# EasyEDA Pro project kuafu01_030内部老化方案.eprj, board PCB4 (continued)
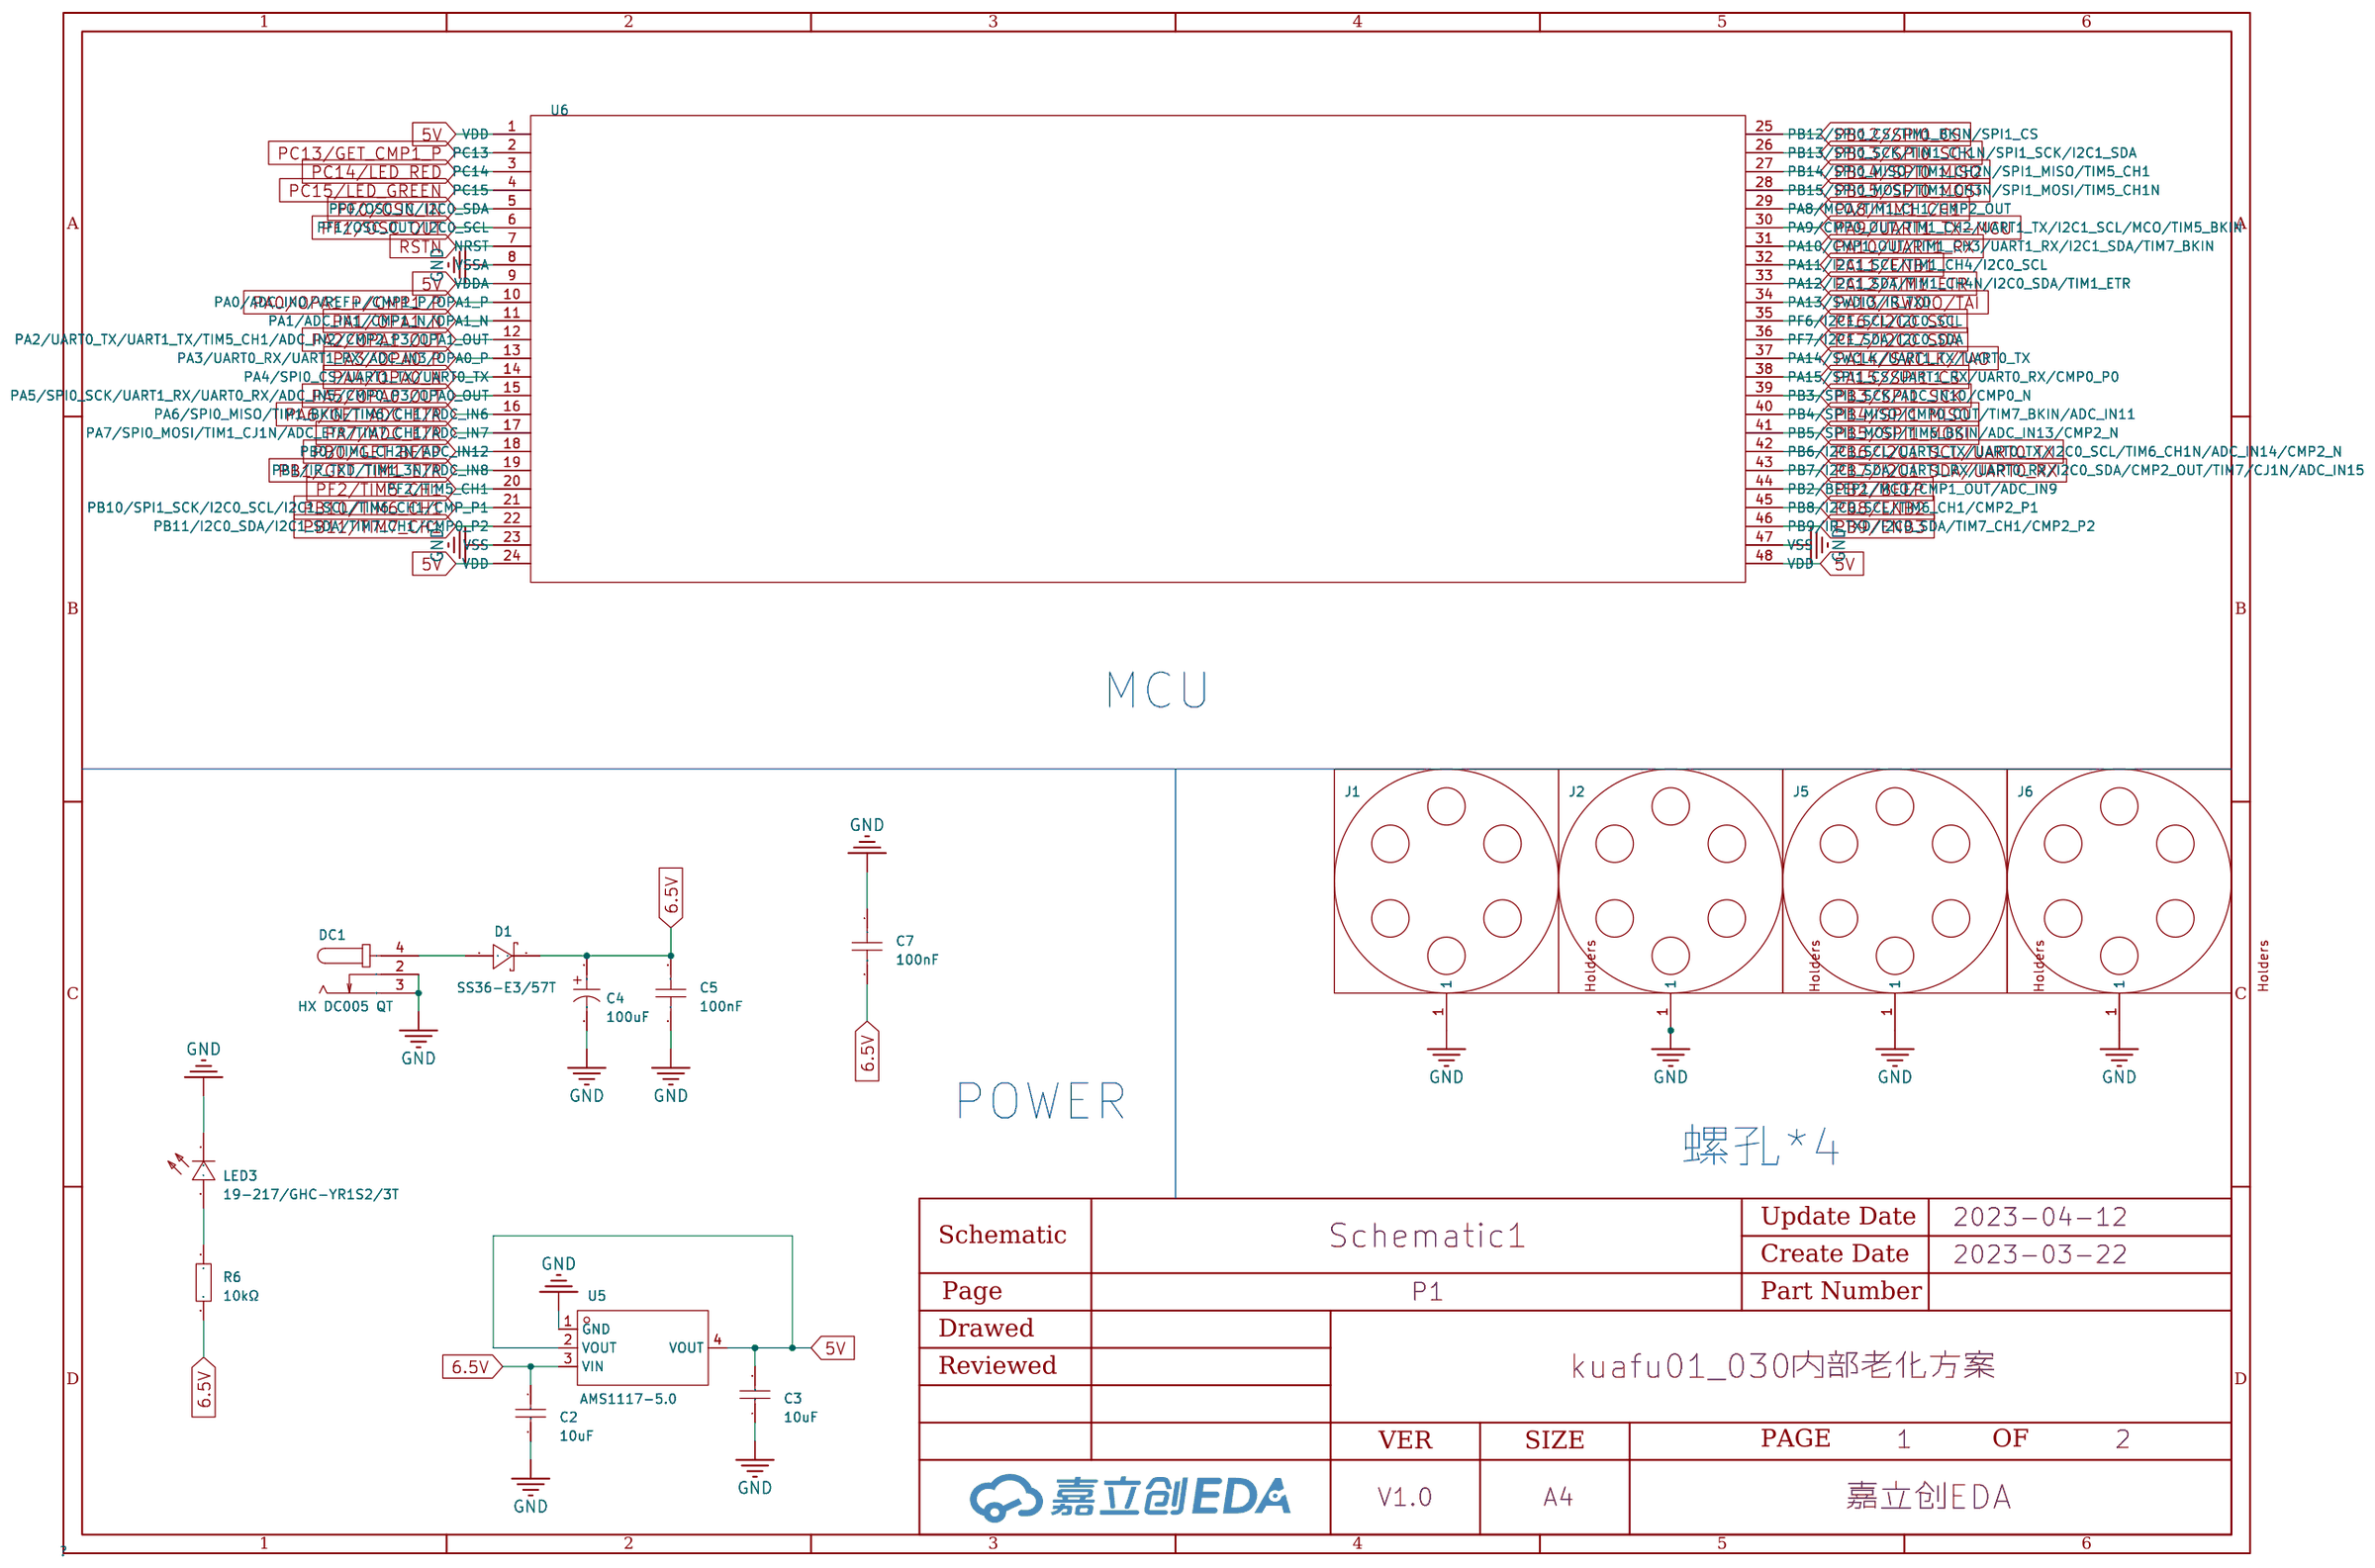
[diagram p0: P1]
## Nets (continued)
GND: C1.2 C1#2.2 C1#3.2 C1#4.2 C1#5.2 C1#6.2 C1#7.2 C1#8.2 C1#9.2 C1#10.2 C1#11.2 C1#12.2 C1#13.2 C1#14.2 C1#15.2 C1#16.2 C1#17.2 C1#18.2 C1#19.2 C1#20.2 C1#21.2 C1#22.2 C1#23.2 C1#24.2 C1#25.2 C1#26.2 C1#27.2 C1#28.2 C1#29.2 C1#30.2 C1#31.2 C1#32.2 C1#33.2 C1#34.2 C1#35.2 C1#36.2 C1#37.2 C1#38.2 C1#39.2 C1#40.2 C2.2 C3.1 C3#2.1 C3#3.1 C3#4.1 C4.2 C5.1 C6.1 C6#2.1 C6#3.1 C6#4.1 C6#5.1 C6#6.1 C6#7.1 C6#8.1 C6#9.1 C6#10.1 C6#11.1 C6#12.1 C6#13.1 C6#14.1 C6#15.1 C6#16.1 C6#17.1 C6#18.1 C6#19.1 C6#20.1 C6#21.1 C6#22.1 C6#23.1 C6#24.1 C6#25.1 C6#26.1 C6#27.1 C6#28.1 C6#29.1 C6#30.1 C6#31.1 C6#32.1 C6#33.1 C6#34.1 C6#35.1 C6#36.1 C6#37.1 C6#38.1 C6#39.1 C6#40.1 C7.1 CN1.9 CN1#2.9 CN1#3.9 CN1#4.9 CN1#5.9 CN1#6.9 CN1#7.9 CN1#8.9 CN1#9.9 CN1#10.9 CN1#11.9 CN1#12.9 CN1#13.9 CN1#14.9 CN1#15.9 CN1#16.9 CN1#17.9 CN1#18.9 CN1#19.9 CN1#20.9 CN1#21.9 CN1#22.9 CN1#23.9 CN1#24.9 CN1#25.9 CN1#26.9 CN1#27.9 CN1#28.9 CN1#29.9 CN1#30.9 CN1#31.9 CN1#32.9 CN1#33.9 CN1#34.9 CN1#35.9 CN1#36.9 CN1#37.9 CN1#38.9 CN1#39.9 CN1#40.9 CN2.3 CN2#2.3 CN2#3.3 CN2#4.3 CN2#5.3 CN2#6.3 CN2#7.3 CN2#8.3 CN2#9.3 CN2#10.3 CN2#11.3 CN2#12.3 CN2#13.3 CN2#14.3 CN2#15.3 CN2#16.3 CN2#17.3 CN2#18.3 CN2#19.3 CN2#20.3 CN2#21.3 CN2#22.3 CN2#23.3 CN2#24.3 CN2#25.3 CN2#26.3 CN2#27.3 CN2#28.3 CN2#29.3 CN2#30.3 CN2#31.3 CN2#32.3 CN2#33.3 CN2#34.3 CN2#35.3 CN2#36.3 CN2#37.3 CN2#38.3 CN2#39.3 CN2#40.3 DC1.2 DC1.3 J1.1 J2.1 J5.1 J6.1 LED3.1 U1.3 U1#2.3 U1#3.3 U1#4.3 U1#5.3 U1#6.3 U1#7.3 U1#8.3 U1#9.3 U1#10.3 U1#11.3 U1#12.3 U1#13.3 U1#14.3 U1#15.3 U1#16.3 U1#17.3 U1#18.3 U1#19.3 U1#20.3 U1#21.3 U1#22.3 U1#23.3 U1#24.3 U1#25.3 U1#26.3 U1#27.3 U1#28.3 U1#29.3 U1#30.3 U1#31.3 U1#32.3 U1#33.3 U1#34.3 U1#35.3 U1#36.3 U1#37.3 U1#38.3 U1#39.3 U1#40.3 U2.2 U2#2.2 U2#3.2 U2#4.2 U2#5.2 U2#6.2 U2#7.2 U2#8.2 U2#9.2 U2#10.2 U2#11.2 U2#12.2 U2#13.2 U2#14.2 U2#15.2 U2#16.2 U2#17.2 U2#18.2 U2#19.2 U2#20.2 U2#21.2 U2#22.2 U2#23.2 U2#24.2 U2#25.2 U2#26.2 U2#27.2 U2#28.2 U2#29.2 U2#30.2 U2#31.2 U2#32.2 U2#33.2 U2#34.2 U2#35.2 U2#36.2 U2#37.2 U2#38.2 U2#39.2 U2#40.2 U3.2 U3#2.2 U3#3.2 U3#4.2 U3#5.2 U3#6.2 U3#7.2 U3#8.2 U3#9.2 U3#10.2 U3#11.2 U3#12.2 U3#13.2 U3#14.2 U3#15.2 U3#16.2 U3#17.2 U3#18.2 U3#19.2 U3#20.2 U3#21.2 U3#22.2 U3#23.2 U3#24.2 U3#25.2 U3#26.2 U3#27.2 U3#28.2 U3#29.2 U3#30.2 U3#31.2 U3#32.2 U3#33.2 U3#34.2 U3#35.2 U3#36.2 U3#37.2 U3#38.2 U3#39.2 U3#40.2 U4.2 U4#2.2 U4#3.2 U4#4.2 U4#5.2 U4#6.2 U4#7.2 U4#8.2 U4#9.2 U4#10.2 U4#11.2 U4#12.2 U4#13.2 U4#14.2 U4#15.2 U4#16.2 U4#17.2 U4#18.2 U4#19.2 U4#20.2 U4#21.2 U4#22.2 U4#23.2 U4#24.2 U4#25.2 U4#26.2 U4#27.2 U4#28.2 U4#29.2 U4#30.2 U4#31.2 U4#32.2 U4#33.2 U4#34.2 U4#35.2 U4#36.2 U4#37.2 U4#38.2 U4#39.2 U4#40.2 U5.1 U5#2.1 U5#3.1 U5#4.1 U6.8 U6.23 U6.47 U6#2.8 U6#2.23 U6#2.47 U6#3.8 U6#3.23 U6#3.47 U6#4.8 U6#4.23 U6#4.47 U6#5.8 U6#5.23 U6#5.47 U6#6.8 U6#6.23 U6#6.47 U6#7.8 U6#7.23 U6#7.47 U6#8.8 U6#8.23 U6#8.47 U6#9.8 U6#9.23 U6#9.47 U6#10.8 U6#10.23 U6#10.47 U6#11.8 U6#11.23 U6#11.47 U6#12.8 U6#12.23 U6#12.47 U6#13.8 U6#13.23 U6#13.47 U6#14.8 U6#14.23 U6#14.47 U6#15.8 U6#15.23 U6#15.47 U6#16.8 U6#16.23 U6#16.47 U6#17.8 U6#17.23 U6#17.47 U6#18.8 U6#18.23 U6#18.47 U6#19.8 U6#19.23 U6#19.47 U6#20.8 U6#20.23 U6#20.47 U6#21.8 U6#21.23 U6#21.47 U6#22.8 U6#22.23 U6#22.47 U6#23.8 U6#23.23 U6#23.47 U6#24.8 U6#24.23 U6#24.47 U6#25.8 U6#25.23 U6#25.47 U6#26.8 U6#26.23 U6#26.47 U6#27.8 U6#27.23 U6#27.47 U6#28.8 U6#28.23 U6#28.47 U6#29.8 U6#29.23 U6#29.47 U6#30.8 U6#30.23 U6#30.47 U6#31.8 U6#31.23 U6#31.47 U6#32.8 U6#32.23 U6#32.47 U6#33.8 U6#33.23 U6#33.47 U6#34.8 U6#34.23 U6#34.47 U6#35.8 U6#35.23 U6#35.47 U6#36.8 U6#36.23 U6#36.47 U6#37.8 U6#37.23 U6#37.47 U6#38.8 U6#38.23 U6#38.47 U6#39.8 U6#39.23 U6#39.47 U6#40.8 U6#40.23 U6#40.47 X1.2 X1.4 X1#2.2 X1#2.4 X1#3.2 X1#3.4 X1#4.2 X1#4.4 X1#5.2 X1#5.4 X1#6.2 X1#6.4 X1#7.2 X1#7.4 X1#8.2 X1#8.4 X1#9.2 X1#9.4 X1#10.2 X1#10.4 X1#11.2 X1#11.4 X1#12.2 X1#12.4 X1#13.2 X1#13.4 X1#14.2 X1#14.4 X1#15.2 X1#15.4 X1#16.2 X1#16.4 X1#17.2 X1#17.4 X1#18.2 X1#18.4 X1#19.2 X1#19.4 X1#20.2 X1#20.4 X1#21.2 X1#21.4 X1#22.2 X1#22.4 X1#23.2 X1#23.4 X1#24.2 X1#24.4 X1#25.2 X1#25.4 X1#26.2 X1#26.4 X1#27.2 X1#27.4 X1#28.2 X1#28.4 X1#29.2 X1#29.4 X1#30.2 X1#30.4 X1#31.2 X1#31.4 X1#32.2 X1#32.4 X1#33.2 X1#33.4 X1#34.2 X1#34.4 X1#35.2 X1#35.4 X1#36.2 X1#36.4 X1#37.2 X1#37.4 X1#38.2 X1#38.4 X1#39.2 X1#39.4 X1#40.2 X1#40.4
PA0/OPA1_P/CMP1_P: U2.4 U2#2.4 U2#3.4 U2#4.4 U2#5.4 U2#6.4 U2#7.4 U2#8.4 U2#9.4 U2#10.4 U2#11.4 U2#12.4 U2#13.4 U2#14.4 U2#15.4 U2#16.4 U2#17.4 U2#18.4 U2#19.4 U2#20.4 U2#21.4 U2#22.4 U2#23.4 U2#24.4 U2#25.4 U2#26.4 U2#27.4 U2#28.4 U2#29.4 U2#30.4 U2#31.4 U2#32.4 U2#33.4 U2#34.4 U2#35.4 U2#36.4 U2#37.4 U2#38.4 U2#39.4 U2#40.4 U6.10 U6#2.10 U6#3.10 U6#4.10 U6#5.10 U6#6.10 U6#7.10 U6#8.10 U6#9.10 U6#10.10 U6#11.10 U6#12.10 U6#13.10 U6#14.10 U6#15.10 U6#16.10 U6#17.10 U6#18.10 U6#19.10 U6#20.10 U6#21.10 U6#22.10 U6#23.10 U6#24.10 U6#25.10 U6#26.10 U6#27.10 U6#28.10 U6#29.10 U6#30.10 U6#31.10 U6#32.10 U6#33.10 U6#34.10 U6#35.10 U6#36.10 U6#37.10 U6#38.10 U6#39.10 U6#40.10
PA1/OPA1_N: U6.11 U6.12 U6#2.11 U6#2.12 U6#3.11 U6#3.12 U6#4.11 U6#4.12 U6#5.11 U6#5.12 U6#6.11 U6#6.12 U6#7.11 U6#7.12 U6#8.11 U6#8.12 U6#9.11 U6#9.12 U6#10.11 U6#10.12 U6#11.11 U6#11.12 U6#12.11 U6#12.12 U6#13.11 U6#13.12 U6#14.11 U6#14.12 U6#15.11 U6#15.12 U6#16.11 U6#16.12 U6#17.11 U6#17.12 U6#18.11 U6#18.12 U6#19.11 U6#19.12 U6#20.11 U6#20.12 U6#21.11 U6#21.12 U6#22.11 U6#22.12 U6#23.11 U6#23.12 U6#24.11 U6#24.12 U6#25.11 U6#25.12 U6#26.11 U6#26.12 U6#27.11 U6#27.12 U6#28.11 U6#28.12 U6#29.11 U6#29.12 U6#30.11 U6#30.12 U6#31.11 U6#31.12 U6#32.11 U6#32.12 U6#33.11 U6#33.12 U6#34.11 U6#34.12 U6#35.11 U6#35.12 U6#36.11 U6#36.12 U6#37.11 U6#37.12 U6#38.11 U6#38.12 U6#39.11 U6#39.12 U6#40.11 U6#40.12
PA4/OPA0_N: U6.14 U6.15 U6#2.14 U6#2.15 U6#3.14 U6#3.15 U6#4.14 U6#4.15 U6#5.14 U6#5.15 U6#6.14 U6#6.15 U6#7.14 U6#7.15 U6#8.14 U6#8.15 U6#9.14 U6#9.15 U6#10.14 U6#10.15 U6#11.14 U6#11.15 U6#12.14 U6#12.15 U6#13.14 U6#13.15 U6#14.14 U6#14.15 U6#15.14 U6#15.15 U6#16.14 U6#16.15 U6#17.14 U6#17.15 U6#18.14 U6#18.15 U6#19.14 U6#19.15 U6#20.14 U6#20.15 U6#21.14 U6#21.15 U6#22.14 U6#22.15 U6#23.14 U6#23.15 U6#24.14 U6#24.15 U6#25.14 U6#25.15 U6#26.14 U6#26.15 U6#27.14 U6#27.15 U6#28.14 U6#28.15 U6#29.14 U6#29.15 U6#30.14 U6#30.15 U6#31.14 U6#31.15 U6#32.14 U6#32.15 U6#33.14 U6#33.15 U6#34.14 U6#34.15 U6#35.14 U6#35.15 U6#36.14 U6#36.15 U6#37.14 U6#37.15 U6#38.14 U6#38.15 U6#39.14 U6#39.15 U6#40.14 U6#40.15
PA6/GET_ADC_ETR: U6.16 U6.17 U6#2.16 U6#2.17 U6#3.16 U6#3.17 U6#4.16 U6#4.17 U6#5.16 U6#5.17 U6#6.16 U6#6.17 U6#7.16 U6#7.17 U6#8.16 U6#8.17 U6#9.16 U6#9.17 U6#10.16 U6#10.17 U6#11.16 U6#11.17 U6#12.16 U6#12.17 U6#13.16 U6#13.17 U6#14.16 U6#14.17 U6#15.16 U6#15.17 U6#16.16 U6#16.17 U6#17.16 U6#17.17 U6#18.16 U6#18.17 U6#19.16 U6#19.17 U6#20.16 U6#20.17 U6#21.16 U6#21.17 U6#22.16 U6#22.17 U6#23.16 U6#23.17 U6#24.16 U6#24.17 U6#25.16 U6#25.17 U6#26.16 U6#26.17 U6#27.16 U6#27.17 U6#28.16 U6#28.17 U6#29.16 U6#29.17 U6#30.16 U6#30.17 U6#31.16 U6#31.17 U6#32.16 U6#32.17 U6#33.16 U6#33.17 U6#34.16 U6#34.17 U6#35.16 U6#35.17 U6#36.16 U6#36.17 U6#37.16 U6#37.17 U6#38.16 U6#38.17 U6#39.16 U6#39.17 U6#40.16 U6#40.17
PA8/TIM1_CH1: CN1.7 CN1#2.7 CN1#3.7 CN1#4.7 CN1#5.7 CN1#6.7 CN1#7.7 CN1#8.7 CN1#9.7 CN1#10.7 CN1#11.7 CN1#12.7 CN1#13.7 CN1#14.7 CN1#15.7 CN1#16.7 CN1#17.7 CN1#18.7 CN1#19.7 CN1#20.7 CN1#21.7 CN1#22.7 CN1#23.7 CN1#24.7 CN1#25.7 CN1#26.7 CN1#27.7 CN1#28.7 CN1#29.7 CN1#30.7 CN1#31.7 CN1#32.7 CN1#33.7 CN1#34.7 CN1#35.7 CN1#36.7 CN1#37.7 CN1#38.7 CN1#39.7 CN1#40.7 U6.20 U6.29 U6#2.20 U6#2.29 U6#3.20 U6#3.29 U6#4.20 U6#4.29 U6#5.20 U6#5.29 U6#6.20 U6#6.29 U6#7.20 U6#7.29 U6#8.20 U6#8.29 U6#9.20 U6#9.29 U6#10.20 U6#10.29 U6#11.20 U6#11.29 U6#12.20 U6#12.29 U6#13.20 U6#13.29 U6#14.20 U6#14.29 U6#15.20 U6#15.29 U6#16.20 U6#16.29 U6#17.20 U6#17.29 U6#18.20 U6#18.29 U6#19.20 U6#19.29 U6#20.20 U6#20.29 U6#21.20 U6#21.29 U6#22.20 U6#22.29 U6#23.20 U6#23.29 U6#24.20 U6#24.29 U6#25.20 U6#25.29 U6#26.20 U6#26.29 U6#27.20 U6#27.29 U6#28.20 U6#28.29 U6#29.20 U6#29.29 U6#30.20 U6#30.29 U6#31.20 U6#31.29 U6#32.20 U6#32.29 U6#33.20 U6#33.29 U6#34.20 U6#34.29 U6#35.20 U6#35.29 U6#36.20 U6#36.29 U6#37.20 U6#37.29 U6#38.20 U6#38.29 U6#39.20 U6#39.29 U6#40.20 U6#40.29
PA9/UART1_TX-1551B: H1.2 H1#2.2 H1#3.2 H1#4.2 H1#5.2 H1#6.2 H1#7.2 H1#8.2 H1#9.2 H1#10.2 H1#11.2 H1#12.2 H1#13.2 H1#14.2 H1#15.2 H1#16.2 H1#17.2 H1#18.2 H1#19.2 H1#20.2 H1#21.2 H1#22.2 H1#23.2 H1#24.2 H1#25.2 H1#26.2 H1#27.2 H1#28.2 H1#29.2 H1#30.2 H1#31.2 H1#32.2 H1#33.2 H1#34.2 H1#35.2 H1#36.2 H1#37.2 H1#38.2 H1#39.2 H1#40.2 U4.3 U4#2.3 U4#3.3 U4#4.3 U4#5.3 U4#6.3 U4#7.3 U4#8.3 U4#9.3 U4#10.3 U4#11.3 U4#12.3 U4#13.3 U4#14.3 U4#15.3 U4#16.3 U4#17.3 U4#18.3 U4#19.3 U4#20.3 U4#21.3 U4#22.3 U4#23.3 U4#24.3 U4#25.3 U4#26.3 U4#27.3 U4#28.3 U4#29.3 U4#30.3 U4#31.3 U4#32.3 U4#33.3 U4#34.3 U4#35.3 U4#36.3 U4#37.3 U4#38.3 U4#39.3 U4#40.3
PA9/UART1_TX-MCU: CN1.3 CN1#2.3 CN1#3.3 CN1#4.3 CN1#5.3 CN1#6.3 CN1#7.3 CN1#8.3 CN1#9.3 CN1#10.3 CN1#11.3 CN1#12.3 CN1#13.3 CN1#14.3 CN1#15.3 CN1#16.3 CN1#17.3 CN1#18.3 CN1#19.3 CN1#20.3 CN1#21.3 CN1#22.3 CN1#23.3 CN1#24.3 CN1#25.3 CN1#26.3 CN1#27.3 CN1#28.3 CN1#29.3 CN1#30.3 CN1#31.3 CN1#32.3 CN1#33.3 CN1#34.3 CN1#35.3 CN1#36.3 CN1#37.3 CN1#38.3 CN1#39.3 CN1#40.3 H1.1 H1#2.1 H1#3.1 H1#4.1 H1#5.1 H1#6.1 H1#7.1 H1#8.1 H1#9.1 H1#10.1 H1#11.1 H1#12.1 H1#13.1 H1#14.1 H1#15.1 H1#16.1 H1#17.1 H1#18.1 H1#19.1 H1#20.1 H1#21.1 H1#22.1 H1#23.1 H1#24.1 H1#25.1 H1#26.1 H1#27.1 H1#28.1 H1#29.1 H1#30.1 H1#31.1 H1#32.1 H1#33.1 H1#34.1 H1#35.1 H1#36.1 H1#37.1 H1#38.1 H1#39.1 H1#40.1 U6.30 U6#2.30 U6#3.30 U6#4.30 U6#5.30 U6#6.30 U6#7.30 U6#8.30 U6#9.30 U6#10.30 U6#11.30 U6#12.30 U6#13.30 U6#14.30 U6#15.30 U6#16.30 U6#17.30 U6#18.30 U6#19.30 U6#20.30 U6#21.30 U6#22.30 U6#23.30 U6#24.30 U6#25.30 U6#26.30 U6#27.30 U6#28.30 U6#29.30 U6#30.30 U6#31.30 U6#32.30 U6#33.30 U6#34.30 U6#35.30 U6#36.30 U6#37.30 U6#38.30 U6#39.30 U6#40.30
PA10/UART1_RX: CN1.1 CN1#2.1 CN1#3.1 CN1#4.1 CN1#5.1 CN1#6.1 CN1#7.1 CN1#8.1 CN1#9.1 CN1#10.1 CN1#11.1 CN1#12.1 CN1#13.1 CN1#14.1 CN1#15.1 CN1#16.1 CN1#17.1 CN1#18.1 CN1#19.1 CN1#20.1 CN1#21.1 CN1#22.1 CN1#23.1 CN1#24.1 CN1#25.1 CN1#26.1 CN1#27.1 CN1#28.1 CN1#29.1 CN1#30.1 CN1#31.1 CN1#32.1 CN1#33.1 CN1#34.1 CN1#35.1 CN1#36.1 CN1#37.1 CN1#38.1 CN1#39.1 CN1#40.1 U3.3 U3#2.3 U3#3.3 U3#4.3 U3#5.3 U3#6.3 U3#7.3 U3#8.3 U3#9.3 U3#10.3 U3#11.3 U3#12.3 U3#13.3 U3#14.3 U3#15.3 U3#16.3 U3#17.3 U3#18.3 U3#19.3 U3#20.3 U3#21.3 U3#22.3 U3#23.3 U3#24.3 U3#25.3 U3#26.3 U3#27.3 U3#28.3 U3#29.3 U3#30.3 U3#31.3 U3#32.3 U3#33.3 U3#34.3 U3#35.3 U3#36.3 U3#37.3 U3#38.3 U3#39.3 U3#40.3 U6.31 U6#2.31 U6#3.31 U6#4.31 U6#5.31 U6#6.31 U6#7.31 U6#8.31 U6#9.31 U6#10.31 U6#11.31 U6#12.31 U6#13.31 U6#14.31 U6#15.31 U6#16.31 U6#17.31 U6#18.31 U6#19.31 U6#20.31 U6#21.31 U6#22.31 U6#23.31 U6#24.31 U6#25.31 U6#26.31 U6#27.31 U6#28.31 U6#29.31 U6#30.31 U6#31.31 U6#32.31 U6#33.31 U6#34.31 U6#35.31 U6#36.31 U6#37.31 U6#38.31 U6#39.31 U6#40.31
PA11/ENB1: U2.6 U2#2.6 U2#3.6 U2#4.6 U2#5.6 U2#6.6 U2#7.6 U2#8.6 U2#9.6 U2#10.6 U2#11.6 U2#12.6 U2#13.6 U2#14.6 U2#15.6 U2#16.6 U2#17.6 U2#18.6 U2#19.6 U2#20.6 U2#21.6 U2#22.6 U2#23.6 U2#24.6 U2#25.6 U2#26.6 U2#27.6 U2#28.6 U2#29.6 U2#30.6 U2#31.6 U2#32.6 U2#33.6 U2#34.6 U2#35.6 U2#36.6 U2#37.6 U2#38.6 U2#39.6 U2#40.6 U6.32 U6#2.32 U6#3.32 U6#4.32 U6#5.32 U6#6.32 U6#7.32 U6#8.32 U6#9.32 U6#10.32 U6#11.32 U6#12.32 U6#13.32 U6#14.32 U6#15.32 U6#16.32 U6#17.32 U6#18.32 U6#19.32 U6#20.32 U6#21.32 U6#22.32 U6#23.32 U6#24.32 U6#25.32 U6#26.32 U6#27.32 U6#28.32 U6#29.32 U6#30.32 U6#31.32 U6#32.32 U6#33.32 U6#34.32 U6#35.32 U6#36.32 U6#37.32 U6#38.32 U6#39.32 U6#40.32
PA12/TIM1_ETR: U6.19 U6.33 U6#2.19 U6#2.33 U6#3.19 U6#3.33 U6#4.19 U6#4.33 U6#5.19 U6#5.33 U6#6.19 U6#6.33 U6#7.19 U6#7.33 U6#8.19 U6#8.33 U6#9.19 U6#9.33 U6#10.19 U6#10.33 U6#11.19 U6#11.33 U6#12.19 U6#12.33 U6#13.19 U6#13.33 U6#14.19 U6#14.33 U6#15.19 U6#15.33 U6#16.19 U6#16.33 U6#17.19 U6#17.33 U6#18.19 U6#18.33 U6#19.19 U6#19.33 U6#20.19 U6#20.33 U6#21.19 U6#21.33 U6#22.19 U6#22.33 U6#23.19 U6#23.33 U6#24.19 U6#24.33 U6#25.19 U6#25.33 U6#26.19 U6#26.33 U6#27.19 U6#27.33 U6#28.19 U6#28.33 U6#29.19 U6#29.33 U6#30.19 U6#30.33 U6#31.19 U6#31.33 U6#32.19 U6#32.33 U6#33.19 U6#33.33 U6#34.19 U6#34.33 U6#35.19 U6#35.33 U6#36.19 U6#36.33 U6#37.19 U6#37.33 U6#38.19 U6#38.33 U6#39.19 U6#39.33 U6#40.19 U6#40.33
PA13/SWDIO/TAI: CN1.10 CN1#2.10 CN1#3.10 CN1#4.10 CN1#5.10 CN1#6.10 CN1#7.10 CN1#8.10 CN1#9.10 CN1#10.10 CN1#11.10 CN1#12.10 CN1#13.10 CN1#14.10 CN1#15.10 CN1#16.10 CN1#17.10 CN1#18.10 CN1#19.10 CN1#20.10 CN1#21.10 CN1#22.10 CN1#23.10 CN1#24.10 CN1#25.10 CN1#26.10 CN1#27.10 CN1#28.10 CN1#29.10 CN1#30.10 CN1#31.10 CN1#32.10 CN1#33.10 CN1#34.10 CN1#35.10 CN1#36.10 CN1#37.10 CN1#38.10 CN1#39.10 CN1#40.10 CN2.4 CN2#2.4 CN2#3.4 CN2#4.4 CN2#5.4 CN2#6.4 CN2#7.4 CN2#8.4 CN2#9.4 CN2#10.4 CN2#11.4 CN2#12.4 CN2#13.4 CN2#14.4 CN2#15.4 CN2#16.4 CN2#17.4 CN2#18.4 CN2#19.4 CN2#20.4 CN2#21.4 CN2#22.4 CN2#23.4 CN2#24.4 CN2#25.4 CN2#26.4 CN2#27.4 CN2#28.4 CN2#29.4 CN2#30.4 CN2#31.4 CN2#32.4 CN2#33.4 CN2#34.4 CN2#35.4 CN2#36.4 CN2#37.4 CN2#38.4 CN2#39.4 CN2#40.4 U6.34 U6#2.34 U6#3.34 U6#4.34 U6#5.34 U6#6.34 U6#7.34 U6#8.34 U6#9.34 U6#10.34 U6#11.34 U6#12.34 U6#13.34 U6#14.34 U6#15.34 U6#16.34 U6#17.34 U6#18.34 U6#19.34 U6#20.34 U6#21.34 U6#22.34 U6#23.34 U6#24.34 U6#25.34 U6#26.34 U6#27.34 U6#28.34 U6#29.34 U6#30.34 U6#31.34 U6#32.34 U6#33.34 U6#34.34 U6#35.34 U6#36.34 U6#37.34 U6#38.34 U6#39.34 U6#40.34
PA14/SWCLK/TAO: CN1.8 CN1#2.8 CN1#3.8 CN1#4.8 CN1#5.8 CN1#6.8 CN1#7.8 CN1#8.8 CN1#9.8 CN1#10.8 CN1#11.8 CN1#12.8 CN1#13.8 CN1#14.8 CN1#15.8 CN1#16.8 CN1#17.8 CN1#18.8 CN1#19.8 CN1#20.8 CN1#21.8 CN1#22.8 CN1#23.8 CN1#24.8 CN1#25.8 CN1#26.8 CN1#27.8 CN1#28.8 CN1#29.8 CN1#30.8 CN1#31.8 CN1#32.8 CN1#33.8 CN1#34.8 CN1#35.8 CN1#36.8 CN1#37.8 CN1#38.8 CN1#39.8 CN1#40.8 CN2.2 CN2#2.2 CN2#3.2 CN2#4.2 CN2#5.2 CN2#6.2 CN2#7.2 CN2#8.2 CN2#9.2 CN2#10.2 CN2#11.2 CN2#12.2 CN2#13.2 CN2#14.2 CN2#15.2 CN2#16.2 CN2#17.2 CN2#18.2 CN2#19.2 CN2#20.2 CN2#21.2 CN2#22.2 CN2#23.2 CN2#24.2 CN2#25.2 CN2#26.2 CN2#27.2 CN2#28.2 CN2#29.2 CN2#30.2 CN2#31.2 CN2#32.2 CN2#33.2 CN2#34.2 CN2#35.2 CN2#36.2 CN2#37.2 CN2#38.2 CN2#39.2 CN2#40.2 U6.37 U6#2.37 U6#3.37 U6#4.37 U6#5.37 U6#6.37 U6#7.37 U6#8.37 U6#9.37 U6#10.37 U6#11.37 U6#12.37 U6#13.37 U6#14.37 U6#15.37 U6#16.37 U6#17.37 U6#18.37 U6#19.37 U6#20.37 U6#21.37 U6#22.37 U6#23.37 U6#24.37 U6#25.37 U6#26.37 U6#27.37 U6#28.37 U6#29.37 U6#30.37 U6#31.37 U6#32.37 U6#33.37 U6#34.37 U6#35.37 U6#36.37 U6#37.37 U6#38.37 U6#39.37 U6#40.37
PA15/SPI1_CS: U6.25 U6.38 U6#2.25 U6#2.38 U6#3.25 U6#3.38 U6#4.25 U6#4.38 U6#5.25 U6#5.38 U6#6.25 U6#6.38 U6#7.25 U6#7.38 U6#8.25 U6#8.38 U6#9.25 U6#9.38 U6#10.25 U6#10.38 U6#11.25 U6#11.38 U6#12.25 U6#12.38 U6#13.25 U6#13.38 U6#14.25 U6#14.38 U6#15.25 U6#15.38 U6#16.25 U6#16.38 U6#17.25 U6#17.38 U6#18.25 U6#18.38 U6#19.25 U6#19.38 U6#20.25 U6#20.38 U6#21.25 U6#21.38 U6#22.25 U6#22.38 U6#23.25 U6#23.38 U6#24.25 U6#24.38 U6#25.25 U6#25.38 U6#26.25 U6#26.38 U6#27.25 U6#27.38 U6#28.25 U6#28.38 U6#29.25 U6#29.38 U6#30.25 U6#30.38 U6#31.25 U6#31.38 U6#32.25 U6#32.38 U6#33.25 U6#33.38 U6#34.25 U6#34.38 U6#35.25 U6#35.38 U6#36.25 U6#36.38 U6#37.25 U6#37.38 U6#38.25 U6#38.38 U6#39.25 U6#39.38 U6#40.25 U6#40.38
PB0/GET_BEEP: R3.2 R3#2.2 R3#3.2 R3#4.2 R3#5.2 R3#6.2 R3#7.2 R3#8.2 R3#9.2 R3#10.2 R3#11.2 R3#12.2 R3#13.2 R3#14.2 R3#15.2 R3#16.2 R3#17.2 R3#18.2 R3#19.2 R3#20.2 R3#21.2 R3#22.2 R3#23.2 R3#24.2 R3#25.2 R3#26.2 R3#27.2 R3#28.2 R3#29.2 R3#30.2 R3#31.2 R3#32.2 R3#33.2 R3#34.2 R3#35.2 R3#36.2 R3#37.2 R3#38.2 R3#39.2 R3#40.2 U6.18 U6#2.18 U6#3.18 U6#4.18 U6#5.18 U6#6.18 U6#7.18 U6#8.18 U6#9.18 U6#10.18 U6#11.18 U6#12.18 U6#13.18 U6#14.18 U6#15.18 U6#16.18 U6#17.18 U6#18.18 U6#19.18 U6#20.18 U6#21.18 U6#22.18 U6#23.18 U6#24.18 U6#25.18 U6#26.18 U6#27.18 U6#28.18 U6#29.18 U6#30.18 U6#31.18 U6#32.18 U6#33.18 U6#34.18 U6#35.18 U6#36.18 U6#37.18 U6#38.18 U6#39.18 U6#40.18
PB2/BEEP: CN1.6 CN1#2.6 CN1#3.6 CN1#4.6 CN1#5.6 CN1#6.6 CN1#7.6 CN1#8.6 CN1#9.6 CN1#10.6 CN1#11.6 CN1#12.6 CN1#13.6 CN1#14.6 CN1#15.6 CN1#16.6 CN1#17.6 CN1#18.6 CN1#19.6 CN1#20.6 CN1#21.6 CN1#22.6 CN1#23.6 CN1#24.6 CN1#25.6 CN1#26.6 CN1#27.6 CN1#28.6 CN1#29.6 CN1#30.6 CN1#31.6 CN1#32.6 CN1#33.6 CN1#34.6 CN1#35.6 CN1#36.6 CN1#37.6 CN1#38.6 CN1#39.6 CN1#40.6 R3.1 R3#2.1 R3#3.1 R3#4.1 R3#5.1 R3#6.1 R3#7.1 R3#8.1 R3#9.1 R3#10.1 R3#11.1 R3#12.1 R3#13.1 R3#14.1 R3#15.1 R3#16.1 R3#17.1 R3#18.1 R3#19.1 R3#20.1 R3#21.1 R3#22.1 R3#23.1 R3#24.1 R3#25.1 R3#26.1 R3#27.1 R3#28.1 R3#29.1 R3#30.1 R3#31.1 R3#32.1 R3#33.1 R3#34.1 R3#35.1 R3#36.1 R3#37.1 R3#38.1 R3#39.1 R3#40.1 U6.44 U6#2.44 U6#3.44 U6#4.44 U6#5.44 U6#6.44 U6#7.44 U6#8.44 U6#9.44 U6#10.44 U6#11.44 U6#12.44 U6#13.44 U6#14.44 U6#15.44 U6#16.44 U6#17.44 U6#18.44 U6#19.44 U6#20.44 U6#21.44 U6#22.44 U6#23.44 U6#24.44 U6#25.44 U6#26.44 U6#27.44 U6#28.44 U6#29.44 U6#30.44 U6#31.44 U6#32.44 U6#33.44 U6#34.44 U6#35.44 U6#36.44 U6#37.44 U6#38.44 U6#39.44 U6#40.44
PB6/I2C1_SCL/UART0_TX: U3.4 U3#2.4 U3#3.4 U3#4.4 U3#5.4 U3#6.4 U3#7.4 U3#8.4 U3#9.4 U3#10.4 U3#11.4 U3#12.4 U3#13.4 U3#14.4 U3#15.4 U3#16.4 U3#17.4 U3#18.4 U3#19.4 U3#20.4 U3#21.4 U3#22.4 U3#23.4 U3#24.4 U3#25.4 U3#26.4 U3#27.4 U3#28.4 U3#29.4 U3#30.4 U3#31.4 U3#32.4 U3#33.4 U3#34.4 U3#35.4 U3#36.4 U3#37.4 U3#38.4 U3#39.4 U3#40.4 U6.42 U6#2.42 U6#3.42 U6#4.42 U6#5.42 U6#6.42 U6#7.42 U6#8.42 U6#9.42 U6#10.42 U6#11.42 U6#12.42 U6#13.42 U6#14.42 U6#15.42 U6#16.42 U6#17.42 U6#18.42 U6#19.42 U6#20.42 U6#21.42 U6#22.42 U6#23.42 U6#24.42 U6#25.42 U6#26.42 U6#27.42 U6#28.42 U6#29.42 U6#30.42 U6#31.42 U6#32.42 U6#33.42 U6#34.42 U6#35.42 U6#36.42 U6#37.42 U6#38.42 U6#39.42 U6#40.42
PB7/I2C1_SDA/UART0_RX: CN1.5 CN1#2.5 CN1#3.5 CN1#4.5 CN1#5.5 CN1#6.5 CN1#7.5 CN1#8.5 CN1#9.5 CN1#10.5 CN1#11.5 CN1#12.5 CN1#13.5 CN1#14.5 CN1#15.5 CN1#16.5 CN1#17.5 CN1#18.5 CN1#19.5 CN1#20.5 CN1#21.5 CN1#22.5 CN1#23.5 CN1#24.5 CN1#25.5 CN1#26.5 CN1#27.5 CN1#28.5 CN1#29.5 CN1#30.5 CN1#31.5 CN1#32.5 CN1#33.5 CN1#34.5 CN1#35.5 CN1#36.5 CN1#37.5 CN1#38.5 CN1#39.5 CN1#40.5 U4.4 U4#2.4 U4#3.4 U4#4.4 U4#5.4 U4#6.4 U4#7.4 U4#8.4 U4#9.4 U4#10.4 U4#11.4 U4#12.4 U4#13.4 U4#14.4 U4#15.4 U4#16.4 U4#17.4 U4#18.4 U4#19.4 U4#20.4 U4#21.4 U4#22.4 U4#23.4 U4#24.4 U4#25.4 U4#26.4 U4#27.4 U4#28.4 U4#29.4 U4#30.4 U4#31.4 U4#32.4 U4#33.4 U4#34.4 U4#35.4 U4#36.4 U4#37.4 U4#38.4 U4#39.4 U4#40.4 U6.43 U6#2.43 U6#3.43 U6#4.43 U6#5.43 U6#6.43 U6#7.43 U6#8.43 U6#9.43 U6#10.43 U6#11.43 U6#12.43 U6#13.43 U6#14.43 U6#15.43 U6#16.43 U6#17.43 U6#18.43 U6#19.43 U6#20.43 U6#21.43 U6#22.43 U6#23.43 U6#24.43 U6#25.43 U6#26.43 U6#27.43 U6#28.43 U6#29.43 U6#30.43 U6#31.43 U6#32.43 U6#33.43 U6#34.43 U6#35.43 U6#36.43 U6#37.43 U6#38.43 U6#39.43 U6#40.43
PB8/ENB2: U3.6 U3#2.6 U3#3.6 U3#4.6 U3#5.6 U3#6.6 U3#7.6 U3#8.6 U3#9.6 U3#10.6 U3#11.6 U3#12.6 U3#13.6 U3#14.6 U3#15.6 U3#16.6 U3#17.6 U3#18.6 U3#19.6 U3#20.6 U3#21.6 U3#22.6 U3#23.6 U3#24.6 U3#25.6 U3#26.6 U3#27.6 U3#28.6 U3#29.6 U3#30.6 U3#31.6 U3#32.6 U3#33.6 U3#34.6 U3#35.6 U3#36.6 U3#37.6 U3#38.6 U3#39.6 U3#40.6 U6.45 U6#2.45 U6#3.45 U6#4.45 U6#5.45 U6#6.45 U6#7.45 U6#8.45 U6#9.45 U6#10.45 U6#11.45 U6#12.45 U6#13.45 U6#14.45 U6#15.45 U6#16.45 U6#17.45 U6#18.45 U6#19.45 U6#20.45 U6#21.45 U6#22.45 U6#23.45 U6#24.45 U6#25.45 U6#26.45 U6#27.45 U6#28.45 U6#29.45 U6#30.45 U6#31.45 U6#32.45 U6#33.45 U6#34.45 U6#35.45 U6#36.45 U6#37.45 U6#38.45 U6#39.45 U6#40.45
PB9/ENB3: U4.6 U4#2.6 U4#3.6 U4#4.6 U4#5.6 U4#6.6 U4#7.6 U4#8.6 U4#9.6 U4#10.6 U4#11.6 U4#12.6 U4#13.6 U4#14.6 U4#15.6 U4#16.6 U4#17.6 U4#18.6 U4#19.6 U4#20.6 U4#21.6 U4#22.6 U4#23.6 U4#24.6 U4#25.6 U4#26.6 U4#27.6 U4#28.6 U4#29.6 U4#30.6 U4#31.6 U4#32.6 U4#33.6 U4#34.6 U4#35.6 U4#36.6 U4#37.6 U4#38.6 U4#39.6 U4#40.6 U6.46 U6#2.46 U6#3.46 U6#4.46 U6#5.46 U6#6.46 U6#7.46 U6#8.46 U6#9.46 U6#10.46 U6#11.46 U6#12.46 U6#13.46 U6#14.46 U6#15.46 U6#16.46 U6#17.46 U6#18.46 U6#19.46 U6#20.46 U6#21.46 U6#22.46 U6#23.46 U6#24.46 U6#25.46 U6#26.46 U6#27.46 U6#28.46 U6#29.46 U6#30.46 U6#31.46 U6#32.46 U6#33.46 U6#34.46 U6#35.46 U6#36.46 U6#37.46 U6#38.46 U6#39.46 U6#40.46
PB10/TIM6_CH1: U6.21 U6.22 U6#2.21 U6#2.22 U6#3.21 U6#3.22 U6#4.21 U6#4.22 U6#5.21 U6#5.22 U6#6.21 U6#6.22 U6#7.21 U6#7.22 U6#8.21 U6#8.22 U6#9.21 U6#9.22 U6#10.21 U6#10.22 U6#11.21 U6#11.22 U6#12.21 U6#12.22 U6#13.21 U6#13.22 U6#14.21 U6#14.22 U6#15.21 U6#15.22 U6#16.21 U6#16.22 U6#17.21 U6#17.22 U6#18.21 U6#18.22 U6#19.21 U6#19.22 U6#20.21 U6#20.22 U6#21.21 U6#21.22 U6#22.21 U6#22.22 U6#23.21 U6#23.22 U6#24.21 U6#24.22 U6#25.21 U6#25.22 U6#26.21 U6#26.22 U6#27.21 U6#27.22 U6#28.21 U6#28.22 U6#29.21 U6#29.22 U6#30.21 U6#30.22 U6#31.21 U6#31.22 U6#32.21 U6#32.22 U6#33.21 U6#33.22 U6#34.21 U6#34.22 U6#35.21 U6#35.22 U6#36.21 U6#36.22 U6#37.21 U6#37.22 U6#38.21 U6#38.22 U6#39.21 U6#39.22 U6#40.21 U6#40.22
PB13/SPI0_SCK: U6.26 U6.39 U6#2.26 U6#2.39 U6#3.26 U6#3.39 U6#4.26 U6#4.39 U6#5.26 U6#5.39 U6#6.26 U6#6.39 U6#7.26 U6#7.39 U6#8.26 U6#8.39 U6#9.26 U6#9.39 U6#10.26 U6#10.39 U6#11.26 U6#11.39 U6#12.26 U6#12.39 U6#13.26 U6#13.39 U6#14.26 U6#14.39 U6#15.26 U6#15.39 U6#16.26 U6#16.39 U6#17.26 U6#17.39 U6#18.26 U6#18.39 U6#19.26 U6#19.39 U6#20.26 U6#20.39 U6#21.26 U6#21.39 U6#22.26 U6#22.39 U6#23.26 U6#23.39 U6#24.26 U6#24.39 U6#25.26 U6#25.39 U6#26.26 U6#26.39 U6#27.26 U6#27.39 U6#28.26 U6#28.39 U6#29.26 U6#29.39 U6#30.26 U6#30.39 U6#31.26 U6#31.39 U6#32.26 U6#32.39 U6#33.26 U6#33.39 U6#34.26 U6#34.39 U6#35.26 U6#35.39 U6#36.26 U6#36.39 U6#37.26 U6#37.39 U6#38.26 U6#38.39 U6#39.26 U6#39.39 U6#40.26 U6#40.39
PB14/SPI0_MISO: U6.27 U6.40 U6#2.27 U6#2.40 U6#3.27 U6#3.40 U6#4.27 U6#4.40 U6#5.27 U6#5.40 U6#6.27 U6#6.40 U6#7.27 U6#7.40 U6#8.27 U6#8.40 U6#9.27 U6#9.40 U6#10.27 U6#10.40 U6#11.27 U6#11.40 U6#12.27 U6#12.40 U6#13.27 U6#13.40 U6#14.27 U6#14.40 U6#15.27 U6#15.40 U6#16.27 U6#16.40 U6#17.27 U6#17.40 U6#18.27 U6#18.40 U6#19.27 U6#19.40 U6#20.27 U6#20.40 U6#21.27 U6#21.40 U6#22.27 U6#22.40 U6#23.27 U6#23.40 U6#24.27 U6#24.40 U6#25.27 U6#25.40 U6#26.27 U6#26.40 U6#27.27 U6#27.40 U6#28.27 U6#28.40 U6#29.27 U6#29.40 U6#30.27 U6#30.40 U6#31.27 U6#31.40 U6#32.27 U6#32.40 U6#33.27 U6#33.40 U6#34.27 U6#34.40 U6#35.27 U6#35.40 U6#36.27 U6#36.40 U6#37.27 U6#37.40 U6#38.27 U6#38.40 U6#39.27 U6#39.40 U6#40.27 U6#40.40
PB15/SPI0_MOSI: U6.28 U6.41 U6#2.28 U6#2.41 U6#3.28 U6#3.41 U6#4.28 U6#4.41 U6#5.28 U6#5.41 U6#6.28 U6#6.41 U6#7.28 U6#7.41 U6#8.28 U6#8.41 U6#9.28 U6#9.41 U6#10.28 U6#10.41 U6#11.28 U6#11.41 U6#12.28 U6#12.41 U6#13.28 U6#13.41 U6#14.28 U6#14.41 U6#15.28 U6#15.41 U6#16.28 U6#16.41 U6#17.28 U6#17.41 U6#18.28 U6#18.41 U6#19.28 U6#19.41 U6#20.28 U6#20.41 U6#21.28 U6#21.41 U6#22.28 U6#22.41 U6#23.28 U6#23.41 U6#24.28 U6#24.41 U6#25.28 U6#25.41 U6#26.28 U6#26.41 U6#27.28 U6#27.41 U6#28.28 U6#28.41 U6#29.28 U6#29.41 U6#30.28 U6#30.41 U6#31.28 U6#31.41 U6#32.28 U6#32.41 U6#33.28 U6#33.41 U6#34.28 U6#34.41 U6#35.28 U6#35.41 U6#36.28 U6#36.41 U6#37.28 U6#37.41 U6#38.28 U6#38.41 U6#39.28 U6#39.41 U6#40.28 U6#40.41
PC13/GET_CMP1_P: U2.3 U2#2.3 U2#3.3 U2#4.3 U2#5.3 U2#6.3 U2#7.3 U2#8.3 U2#9.3 U2#10.3 U2#11.3 U2#12.3 U2#13.3 U2#14.3 U2#15.3 U2#16.3 U2#17.3 U2#18.3 U2#19.3 U2#20.3 U2#21.3 U2#22.3 U2#23.3 U2#24.3 U2#25.3 U2#26.3 U2#27.3 U2#28.3 U2#29.3 U2#30.3 U2#31.3 U2#32.3 U2#33.3 U2#34.3 U2#35.3 U2#36.3 U2#37.3 U2#38.3 U2#39.3 U2#40.3 U6.2 U6#2.2 U6#3.2 U6#4.2 U6#5.2 U6#6.2 U6#7.2 U6#8.2 U6#9.2 U6#10.2 U6#11.2 U6#12.2 U6#13.2 U6#14.2 U6#15.2 U6#16.2 U6#17.2 U6#18.2 U6#19.2 U6#20.2 U6#21.2 U6#22.2 U6#23.2 U6#24.2 U6#25.2 U6#26.2 U6#27.2 U6#28.2 U6#29.2 U6#30.2 U6#31.2 U6#32.2 U6#33.2 U6#34.2 U6#35.2 U6#36.2 U6#37.2 U6#38.2 U6#39.2 U6#40.2
PC14/LED_RED: R1.1 R1#2.1 R1#3.1 R1#4.1 R1#5.1 R1#6.1 R1#7.1 R1#8.1 R1#9.1 R1#10.1 R1#11.1 R1#12.1 R1#13.1 R1#14.1 R1#15.1 R1#16.1 R1#17.1 R1#18.1 R1#19.1 R1#20.1 R1#21.1 R1#22.1 R1#23.1 R1#24.1 R1#25.1 R1#26.1 R1#27.1 R1#28.1 R1#29.1 R1#30.1 R1#31.1 R1#32.1 R1#33.1 R1#34.1 R1#35.1 R1#36.1 R1#37.1 R1#38.1 R1#39.1 R1#40.1 U6.3 U6#2.3 U6#3.3 U6#4.3 U6#5.3 U6#6.3 U6#7.3 U6#8.3 U6#9.3 U6#10.3 U6#11.3 U6#12.3 U6#13.3 U6#14.3 U6#15.3 U6#16.3 U6#17.3 U6#18.3 U6#19.3 U6#20.3 U6#21.3 U6#22.3 U6#23.3 U6#24.3 U6#25.3 U6#26.3 U6#27.3 U6#28.3 U6#29.3 U6#30.3 U6#31.3 U6#32.3 U6#33.3 U6#34.3 U6#35.3 U6#36.3 U6#37.3 U6#38.3 U6#39.3 U6#40.3
PC15/LED_GREEN: R2.1 R2#2.1 R2#3.1 R2#4.1 R2#5.1 R2#6.1 R2#7.1 R2#8.1 R2#9.1 R2#10.1 R2#11.1 R2#12.1 R2#13.1 R2#14.1 R2#15.1 R2#16.1 R2#17.1 R2#18.1 R2#19.1 R2#20.1 R2#21.1 R2#22.1 R2#23.1 R2#24.1 R2#25.1 R2#26.1 R2#27.1 R2#28.1 R2#29.1 R2#30.1 R2#31.1 R2#32.1 R2#33.1 R2#34.1 R2#35.1 R2#36.1 R2#37.1 R2#38.1 R2#39.1 R2#40.1 U6.4 U6#2.4 U6#3.4 U6#4.4 U6#5.4 U6#6.4 U6#7.4 U6#8.4 U6#9.4 U6#10.4 U6#11.4 U6#12.4 U6#13.4 U6#14.4 U6#15.4 U6#16.4 U6#17.4 U6#18.4 U6#19.4 U6#20.4 U6#21.4 U6#22.4 U6#23.4 U6#24.4 U6#25.4 U6#26.4 U6#27.4 U6#28.4 U6#29.4 U6#30.4 U6#31.4 U6#32.4 U6#33.4 U6#34.4 U6#35.4 U6#36.4 U6#37.4 U6#38.4 U6#39.4 U6#40.4
PF0/OSC_IN: U6.5 U6#2.5 U6#3.5 U6#4.5 U6#5.5 U6#6.5 U6#7.5 U6#8.5 U6#9.5 U6#10.5 U6#11.5 U6#12.5 U6#13.5 U6#14.5 U6#15.5 U6#16.5 U6#17.5 U6#18.5 U6#19.5 U6#20.5 U6#21.5 U6#22.5 U6#23.5 U6#24.5 U6#25.5 U6#26.5 U6#27.5 U6#28.5 U6#29.5 U6#30.5 U6#31.5 U6#32.5 U6#33.5 U6#34.5 U6#35.5 U6#36.5 U6#37.5 U6#38.5 U6#39.5 U6#40.5 X1.1 X1#2.1 X1#3.1 X1#4.1 X1#5.1 X1#6.1 X1#7.1 X1#8.1 X1#9.1 X1#10.1 X1#11.1 X1#12.1 X1#13.1 X1#14.1 X1#15.1 X1#16.1 X1#17.1 X1#18.1 X1#19.1 X1#20.1 X1#21.1 X1#22.1 X1#23.1 X1#24.1 X1#25.1 X1#26.1 X1#27.1 X1#28.1 X1#29.1 X1#30.1 X1#31.1 X1#32.1 X1#33.1 X1#34.1 X1#35.1 X1#36.1 X1#37.1 X1#38.1 X1#39.1 X1#40.1
PF1/OSC_OUT: U6.6 U6#2.6 U6#3.6 U6#4.6 U6#5.6 U6#6.6 U6#7.6 U6#8.6 U6#9.6 U6#10.6 U6#11.6 U6#12.6 U6#13.6 U6#14.6 U6#15.6 U6#16.6 U6#17.6 U6#18.6 U6#19.6 U6#20.6 U6#21.6 U6#22.6 U6#23.6 U6#24.6 U6#25.6 U6#26.6 U6#27.6 U6#28.6 U6#29.6 U6#30.6 U6#31.6 U6#32.6 U6#33.6 U6#34.6 U6#35.6 U6#36.6 U6#37.6 U6#38.6 U6#39.6 U6#40.6 X1.3 X1#2.3 X1#3.3 X1#4.3 X1#5.3 X1#6.3 X1#7.3 X1#8.3 X1#9.3 X1#10.3 X1#11.3 X1#12.3 X1#13.3 X1#14.3 X1#15.3 X1#16.3 X1#17.3 X1#18.3 X1#19.3 X1#20.3 X1#21.3 X1#22.3 X1#23.3 X1#24.3 X1#25.3 X1#26.3 X1#27.3 X1#28.3 X1#29.3 X1#30.3 X1#31.3 X1#32.3 X1#33.3 X1#34.3 X1#35.3 X1#36.3 X1#37.3 X1#38.3 X1#39.3 X1#40.3
PF6/I2C0_SCL: R4.1 R4#2.1 R4#3.1 R4#4.1 R4#5.1 R4#6.1 R4#7.1 R4#8.1 R4#9.1 R4#10.1 R4#11.1 R4#12.1 R4#13.1 R4#14.1 R4#15.1 R4#16.1 R4#17.1 R4#18.1 R4#19.1 R4#20.1 R4#21.1 R4#22.1 R4#23.1 R4#24.1 R4#25.1 R4#26.1 R4#27.1 R4#28.1 R4#29.1 R4#30.1 R4#31.1 R4#32.1 R4#33.1 R4#34.1 R4#35.1 R4#36.1 R4#37.1 R4#38.1 R4#39.1 R4#40.1 U3.1 U3#2.1 U3#3.1 U3#4.1 U3#5.1 U3#6.1 U3#7.1 U3#8.1 U3#9.1 U3#10.1 U3#11.1 U3#12.1 U3#13.1 U3#14.1 U3#15.1 U3#16.1 U3#17.1 U3#18.1 U3#19.1 U3#20.1 U3#21.1 U3#22.1 U3#23.1 U3#24.1 U3#25.1 U3#26.1 U3#27.1 U3#28.1 U3#29.1 U3#30.1 U3#31.1 U3#32.1 U3#33.1 U3#34.1 U3#35.1 U3#36.1 U3#37.1 U3#38.1 U3#39.1 U3#40.1 U6.35 U6#2.35 U6#3.35 U6#4.35 U6#5.35 U6#6.35 U6#7.35 U6#8.35 U6#9.35 U6#10.35 U6#11.35 U6#12.35 U6#13.35 U6#14.35 U6#15.35 U6#16.35 U6#17.35 U6#18.35 U6#19.35 U6#20.35 U6#21.35 U6#22.35 U6#23.35 U6#24.35 U6#25.35 U6#26.35 U6#27.35 U6#28.35 U6#29.35 U6#30.35 U6#31.35 U6#32.35 U6#33.35 U6#34.35 U6#35.35 U6#36.35 U6#37.35 U6#38.35 U6#39.35 U6#40.35
PF7/I2C0_SDA: R5.1 R5#2.1 R5#3.1 R5#4.1 R5#5.1 R5#6.1 R5#7.1 R5#8.1 R5#9.1 R5#10.1 R5#11.1 R5#12.1 R5#13.1 R5#14.1 R5#15.1 R5#16.1 R5#17.1 R5#18.1 R5#19.1 R5#20.1 R5#21.1 R5#22.1 R5#23.1 R5#24.1 R5#25.1 R5#26.1 R5#27.1 R5#28.1 R5#29.1 R5#30.1 R5#31.1 R5#32.1 R5#33.1 R5#34.1 R5#35.1 R5#36.1 R5#37.1 R5#38.1 R5#39.1 R5#40.1 U4.1 U4#2.1 U4#3.1 U4#4.1 U4#5.1 U4#6.1 U4#7.1 U4#8.1 U4#9.1 U4#10.1 U4#11.1 U4#12.1 U4#13.1 U4#14.1 U4#15.1 U4#16.1 U4#17.1 U4#18.1 U4#19.1 U4#20.1 U4#21.1 U4#22.1 U4#23.1 U4#24.1 U4#25.1 U4#26.1 U4#27.1 U4#28.1 U4#29.1 U4#30.1 U4#31.1 U4#32.1 U4#33.1 U4#34.1 U4#35.1 U4#36.1 U4#37.1 U4#38.1 U4#39.1 U4#40.1 U6.36 U6#2.36 U6#3.36 U6#4.36 U6#5.36 U6#6.36 U6#7.36 U6#8.36 U6#9.36 U6#10.36 U6#11.36 U6#12.36 U6#13.36 U6#14.36 U6#15.36 U6#16.36 U6#17.36 U6#18.36 U6#19.36 U6#20.36 U6#21.36 U6#22.36 U6#23.36 U6#24.36 U6#25.36 U6#26.36 U6#27.36 U6#28.36 U6#29.36 U6#30.36 U6#31.36 U6#32.36 U6#33.36 U6#34.36 U6#35.36 U6#36.36 U6#37.36 U6#38.36 U6#39.36 U6#40.36
RSTN: CN1.2 CN1#2.2 CN1#3.2 CN1#4.2 CN1#5.2 CN1#6.2 CN1#7.2 CN1#8.2 CN1#9.2 CN1#10.2 CN1#11.2 CN1#12.2 CN1#13.2 CN1#14.2 CN1#15.2 CN1#16.2 CN1#17.2 CN1#18.2 CN1#19.2 CN1#20.2 CN1#21.2 CN1#22.2 CN1#23.2 CN1#24.2 CN1#25.2 CN1#26.2 CN1#27.2 CN1#28.2 CN1#29.2 CN1#30.2 CN1#31.2 CN1#32.2 CN1#33.2 CN1#34.2 CN1#35.2 CN1#36.2 CN1#37.2 CN1#38.2 CN1#39.2 CN1#40.2 U6.7 U6#2.7 U6#3.7 U6#4.7 U6#5.7 U6#6.7 U6#7.7 U6#8.7 U6#9.7 U6#10.7 U6#11.7 U6#12.7 U6#13.7 U6#14.7 U6#15.7 U6#16.7 U6#17.7 U6#18.7 U6#19.7 U6#20.7 U6#21.7 U6#22.7 U6#23.7 U6#24.7 U6#25.7 U6#26.7 U6#27.7 U6#28.7 U6#29.7 U6#30.7 U6#31.7 U6#32.7 U6#33.7 U6#34.7 U6#35.7 U6#36.7 U6#37.7 U6#38.7 U6#39.7 U6#40.7